# EAGLE design BMM (EAGLE 6.5.0)
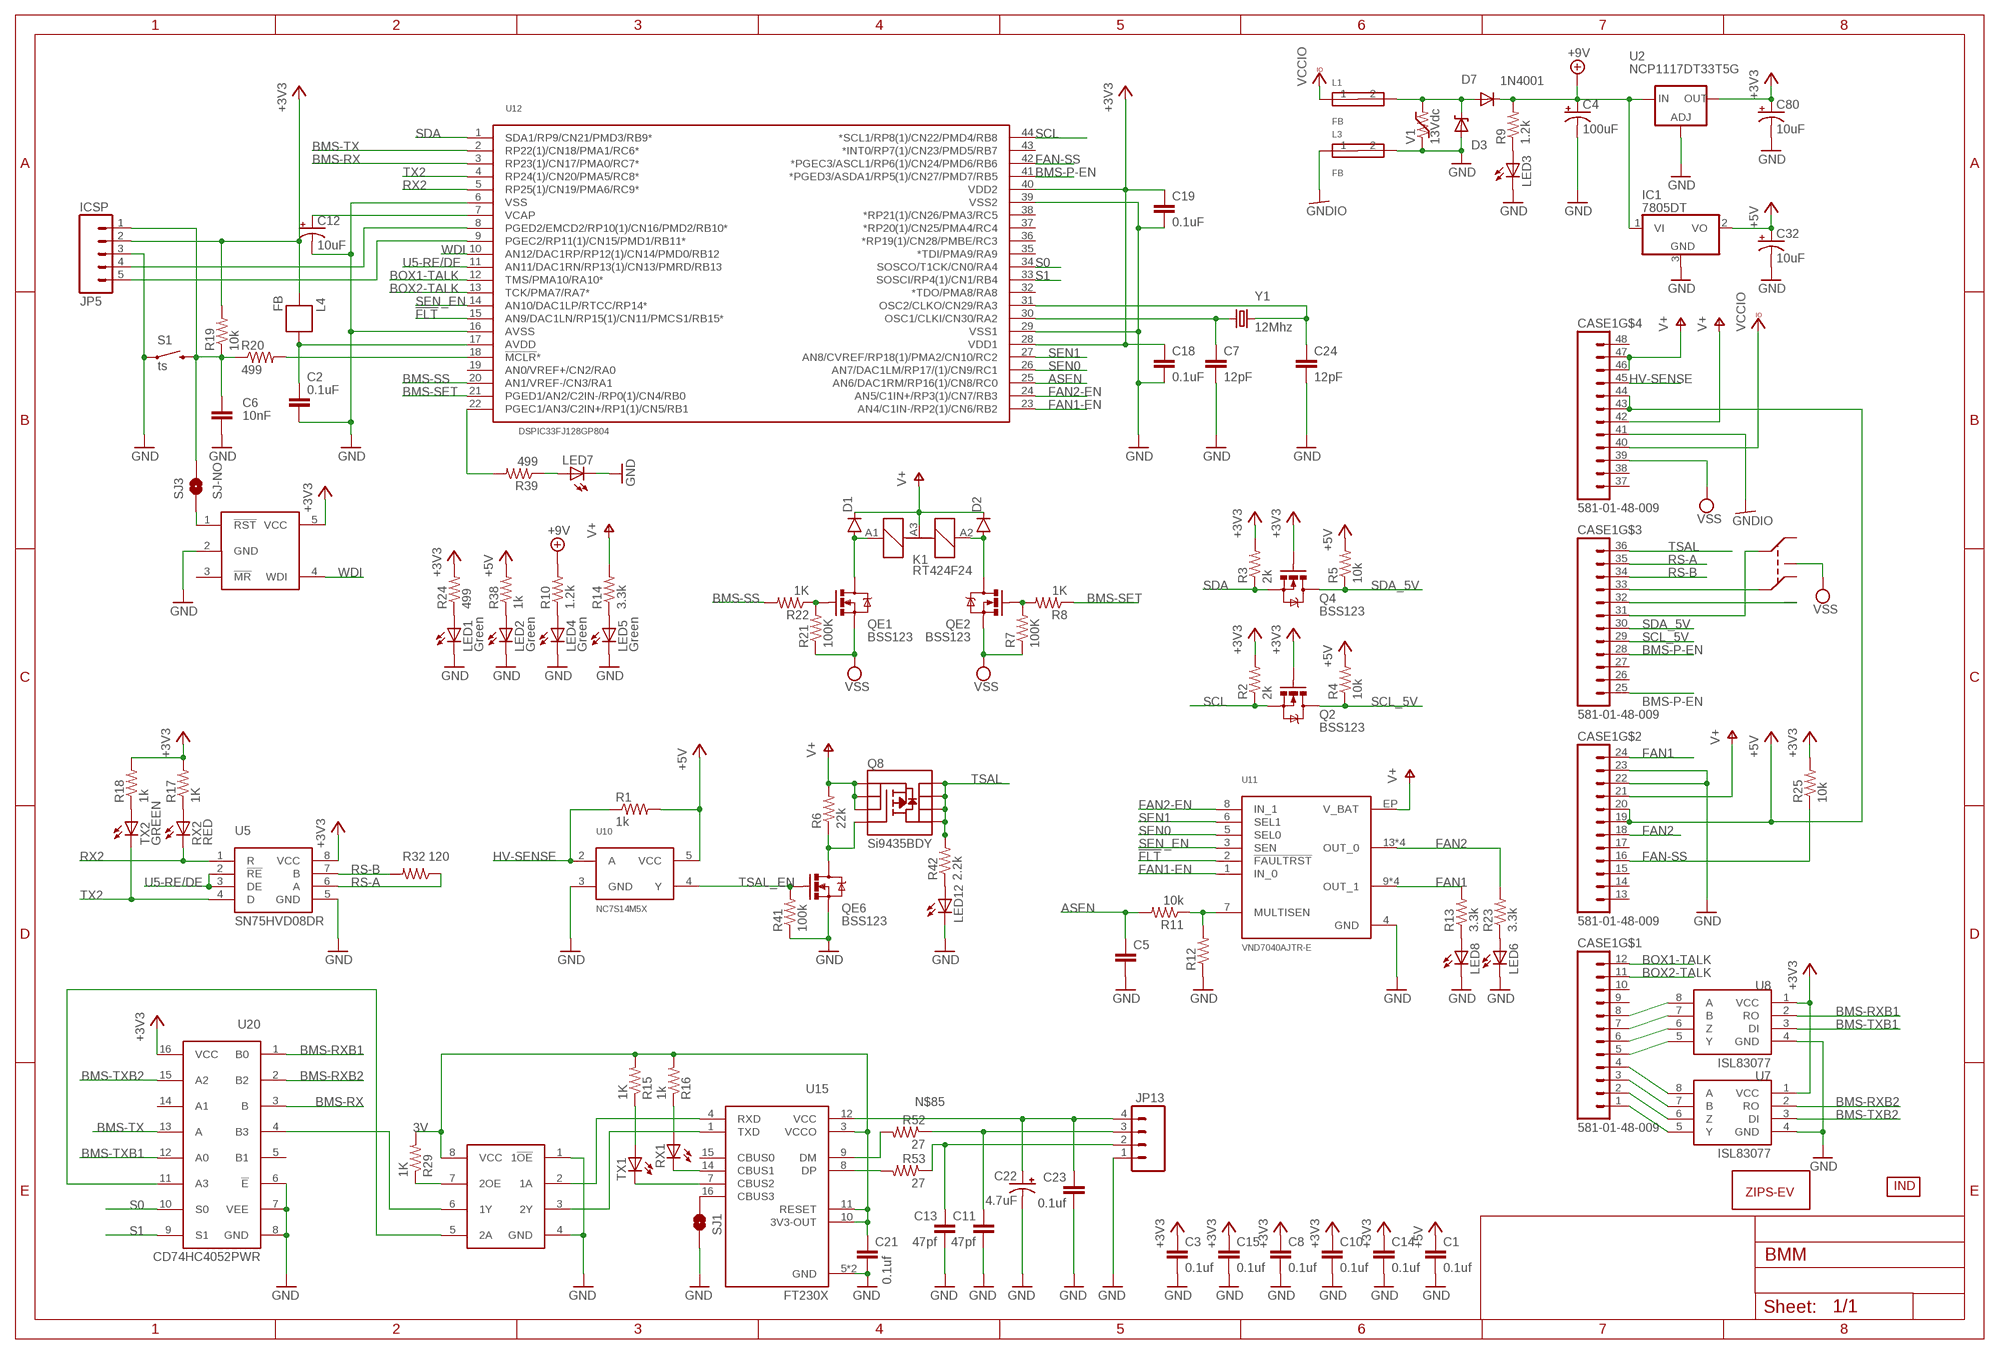
[diagram p0: schematic, sheet 1]

## Parts
C1  0.1uf  CAP0805  [0805]
C2  0.1uF  CAP0805  [0805]
C3  0.1uf  CAP0805  [0805]
C4  100uF  CAP_POL7343  [EIA7343]
C5  CAP0805  [0805]
C6  10nF  CAP0805  [0805]
C7  12pF  CAP0805  [0805]
C8  0.1uf  CAP0805  [0805]
C10  0.1uf  CAP0805  [0805]
C11  47pf  CAP0805  [0805]
C12  10uF  10UF-TANT  [EIA3216]
C13  47pf  CAP0805  [0805]
C14  0.1uf  CAP0805  [0805]
C15  0.1uf  CAP0805  [0805]
C18  0.1uF  CAP0805  [0805]
C19  0.1uF  CAP0805  [0805]
C21  0.1uf  CAP0805  [0805]
C22  4.7uF  CAP_POL1206  [EIA3216]
C23  0.1uf  CAP0805  [0805]
C24  12pF  CAP0805  [0805]
C32  10uF  POLCAP  [POLC1206]
C80  10uF  POLCAP  [POLC1206]
CASE1  581-01-48-009  [581-01-48-009]
D1  DIODESMA  [SMA-DIODE]
D2  DIODESMA  [SMA-DIODE]
D3  MM5Z30  [SOD-523F]
D7  1N4001  DIODE-SOD123  [SOD123]
IC1  7805DT  [TO252]
JP5  ICSP  M05LOCK_LONGPADS  [1X05_LOCK_LONGPADS]
JP13  M04POLAR_LOCK  [MOLEX-1X4_LOCK]
K1  RT424F24  [RT424F24]
L1  FB  FERITEBEAD  [0603]
L3  FB  FERITEBEAD  [0603]
L4  FB  [0603]
LED1  Green  LEDCHIPLED_0805  [CHIPLED_0805]
LED2  Green  LEDCHIPLED_0805  [CHIPLED_0805]
LED3  LEDCHIP-LED0805  [CHIP-LED0805]
LED4  Green  LEDCHIPLED_0805  [CHIPLED_0805]
LED5  Green  LEDCHIPLED_0805  [CHIPLED_0805]
LED6  LEDCHIPLED_0805  [CHIPLED_0805]
LED7  LEDCHIP-LED0805  [CHIP-LED0805]
LED8  LEDCHIPLED_0805  [CHIPLED_0805]
LED12  LEDCHIP-LED0805  [CHIP-LED0805]
Q2  BSS123  MOSFET-NCHANNELBSS123LT1G  [SOT23-3]
Q4  BSS123  MOSFET-NCHANNELBSS123LT1G  [SOT23-3]
Q8  Si9435BDY  MOSFET-PCHANNEL-SOIC8SOIC8  [SO08]
QE1  BSS123  [SOT-23]
QE2  BSS123  [SOT-23]
QE6  BSS123  [SOT-23]
R1  1k  RESISTOR0805-RES  [0805]
R2  2k  RESISTOR0805-RES  [0805]
R3  2k  RESISTOR0805-RES  [0805]
R4  10k  RESISTOR0805-RES  [0805]
R5  10k  RESISTOR0805-RES  [0805]
R6  22k  RESISTOR0805-RES  [0805]
R7  100K  R-US_R0805  [R0805]
R8  1K  R-US_R0805  [R0805]
R9  1.2k  R-US_R0805  [R0805]
R10  1.2k  R-US_R0805  [R0805]
R11  10k  RESISTOR0805-RES  [0805]
R12  RESISTOR0805-RES  [0805]
R13  3.3k  RESISTOR0805-RES  [0805]
R14  3.3k  R-US_R0805  [R0805]
R15  1K  R-US_R0805  [R0805]
R16  1k  R-US_R0805  [R0805]
R17  1K  R-US_R0805  [R0805]
R18  1k  R-US_R0805  [R0805]
R19  10k  RESISTOR0805-RES  [0805]
R20  499  RESISTOR0805-RES  [0805]
R21  100K  R-US_R0805  [R0805]
R22  1K  R-US_R0805  [R0805]
R23  3.3k  RESISTOR0805-RES  [0805]
R24  499  R-US_R0805  [R0805]
R25  10k  RESISTOR0805-RES  [0805]
R29  1K  R-US_R0805  [R0805]
R32  120  R-US_R0805  [R0805]
R38  1k  R-US_R0805  [R0805]
R39  499  RESISTOR0805-RES  [0805]
R41  100k  RESISTOR0805-RES  [0805]
R42  2.2k  RESISTOR0805-RES  [0805]
R52  27  RESISTOR0805-RES  [0805]
R53  27  RESISTOR0805-RES  [0805]
RX1  LEDCHIPLED_0805  [CHIPLED_0805]
RX2  RED  LEDCHIPLED_0805  [CHIPLED_0805]
S1  ts  SWITCH-MOMENTARY-2PTH  [TACTILE-PTH]
SJ1  JUMPER-PAD-2-NOYES_SILK  [PAD-JUMPER-2-NO_YES_SILK]
SJ3  SJ-NO  SOLDERJUMPERNO  [SJ_2S-NO]
TX1  LEDCHIPLED_0805  [CHIPLED_0805]
TX2  GREEN  LEDCHIPLED_0805  [CHIPLED_0805]
U2  NCP1117DT33T5G  V_REG_317DPACK  [V-REG_DPACK]
U4  SN74LVC2G241DCTR  [VFSOP-8]
U5  SN75HVD08DR  [SO-8]
U7  ISL83077  [SO08]
U8  ISL83077  [SO08]
U9  MAX823  [SOT23-5L]
U10  NC7S14M5X  [SOT23-5]
U11  VND7040AJTR-E  [SSO-16-POWER]
U12  DSPIC33FJ128GP804  [TQFP-44]
U15  FT230X  [SSOP-16]
U20  CD74HC4052PWR  [TSSOP-16]
U$1  LOGOM  [L-M]
U$2  INDPK1  [PICKIT-PIN-1]
V1  13Vdc  VAR-RES  [0603]
Y1  12Mhz  CRYSTAL5X3  [CRYSTAL-SMD-5X3]

## Nets
3V: C21.1 R15.2 R16.2 R29.2 U4.8(VCC) U15.3(VCCO) U15.10(3V3-OUT) U15.11(RESET)
!FLT: U11.2(!FAULTRST) U12.15(AN9/DAC1LN/RP15(1)/CN11/PMCS1/RB15*)
+3V3: C3.1 C8.1 C10.1 C14.1 C15.1 C18.1 C19.1 C80.1(+) JP5.2 L4.2 Q2.1(G) Q4.1(G) R2.2 R3.2 R17.2 R18.2 R19.2 R24.2 R25.2 U2.4(OUT) U5.8(VCC) U7.1(VCC) U8.1(VCC) U9.5(VCC) U12.28(VDD1) U12.40(VDD2) U20.16(VCC)
+5V: C1.1 C32.1(+) CASE1.19 CASE1.20 CASE1.43 CASE1.44 IC1.2(VO) R1.2 R4.2 R5.2 R38.2 U10.5(VCC)
+9V: C4.A(+) D7.C IC1.1(VI) R9.2 R10.2 U2.3(IN)
ASEN: C5.1 R11.2 U12.25(AN6/DAC1RM/RP16(1)/CN8/RC0)
BMS-P-EN: CASE1.25 CASE1.28 U12.41(*PGED3/ASDA1/RP5(1)/CN27/PMD7/RB5)
BMS-RX: U12.3(RP23(1)/CN17/PMA0/RC7*) U20.3(B)
BMS-RXB1: U8.2(RO) U20.1(B0)
BMS-RXB2: U7.2(RO) U20.2(B2)
BMS-SET: R8.1 U12.21(PGED1/AN2/C2IN-/RP0(1)/CN4/RB0)
BMS-SS: R22.2 U12.20(AN1/VREF-/CN3/RA1)
BMS-TX: U12.2(RP22(1)/CN18/PMA1/RC6*) U20.13(A)
BMS-TXB1: U8.3(DI) U20.12(A0)
BMS-TXB2: U7.3(DI) U20.15(A2)
BOX1-TALK: CASE1.12 U12.12(TMS/PMA10/RA10*)
BOX2-TALK: CASE1.11 U12.13(TCK/PMA7/RA7*)
C_N: C7.1 U12.30(OSC1/CLKI/CN30/RA2) Y1.1
C_P: C24.1 U12.31(OSC2/CLKO/CN29/RA3) Y1.3
FAN1: CASE1.24 R13.2 U11.9(OUT_1) U11.10(OUT_1) U11.11(OUT_1) U11.12(OUT_1)
FAN1-EN: U11.1(IN_0) U12.23(AN4/C1IN-/RP2(1)/CN6/RB2)
FAN2: CASE1.18 R23.2 U11.13(OUT_0) U11.14(OUT_0) U11.15(OUT_0) U11.16(OUT_0)
FAN2-EN: U11.8(IN_1) U12.24(AN5/C1IN+/RP3(1)/CN7/RB3)
FAN-SS: CASE1.16 R25.1 U12.42(*PGEC3/ASCL1/RP6(1)/CN24/PMD6/RB6)
GND: C1.2 C2.2 C3.2 C4.C(-) C5.2 C6.2 C7.2 C8.2 C10.2 C11.2 C12.C(-) C13.2 C14.2 C15.2 C18.2 C19.2 C21.2 C22.C(-) C23.2 C24.2 C32.2(-) C80.2(-) CASE1.22 CASE1.23 D3.A IC1.3(GND) JP5.3 JP13.1 L3.2 LED1.C LED2.C LED3.C LED4.C LED5.C LED6.C LED7.C LED8.C LED12.C QE6.2(S) R12.1 R41.1 S1.1 SJ1.1 U2.1(ADJ) U4.1(1!OE) U4.4(GND) U5.5(GND) U7.4(GND) U8.4(GND) U9.2(GND) U10.3(GND) U11.4(GND) U12.6(VSS) U12.16(AVSS) U12.29(VSS1) U12.39(VSS2) U15.5(GND) U15.13(GND) U20.6(!E) U20.7(VEE) U20.8(GND) V1.1
GNDIO: CASE1.41 L3.1
HV-SENSE: CASE1.45 R1.1 U10.2(A)
N$1: LED8.A R13.1
N$3: D1.A K1.A1(+1) QE1.3(D)
N$4: LED1.A R24.1
N$5: D2.A K1.A2(+2) QE2.3(D)
N$6: LED6.A R23.1
N$7: QE2.1(G) R7.2 R8.2
N$8: LED3.A R9.1
N$10: R11.1 R12.2 U11.7(MULTISEN)
N$11: LED4.A R10.1
N$12: LED5.A R14.1
N$13: CASE1.33 K1.21(C2)
N$14: R52.2 U15.9(DM)
N$15: R15.1 TX1.A
N$16: R16.1 RX1.A
N$17: TX1.C U15.7(CBUS2)
N$18: RX1.C U15.14(CBUS1)
N$19: R18.1 TX2.A
N$20: U4.2(1A) U15.4(RXD)
N$21: U4.3(2Y) U15.1(TXD)
N$22: LED2.A R38.1
N$23: LED7.A R39.1
N$25: CASE1.1 U7.5(Y)
N$27: SJ3.1 U9.1(!RST)
N$28: C2.1 L4.1 U12.17(AVDD)
N$29: C12.A(+) U12.7(VCAP)
N$30: QE1.1(G) R21.2 R22.1
N$31: CASE1.2 U7.6(Z)
N$33: CASE1.3 U7.7(B)
N$34: CASE1.4 U7.8(A)
N$35: CASE1.5 U8.5(Y)
N$36: CASE1.32 K1.24(NO2)
N$37: CASE1.6 U8.6(Z)
N$38: CASE1.7 U8.7(B)
N$39: CASE1.8 U8.8(A)
N$40: R17.1 RX2.A
N$42: CASE1.31 K1.11(C1)
N$43: Q8.4(G) QE6.3(D) R6.1
N$44: R39.2 U12.22(PGEC1/AN3/C2IN+/RP1(1)/CN5/RB1)
N$45: C6.1 JP5.1 R19.1 R20.1 S1.3 SJ3.2
N$46: R20.2 U12.18(!MCLR!*)
N$47: JP5.4 U12.8(PGED2/EMCD2/RP10(1)/CN16/PMD2/RB10*)
N$48: JP5.5 U12.9(PGEC2/RP11(1)/CN15/PMD1/RB11*)
N$50: LED12.A R42.1
N$54: R53.2 U15.8(DP)
N$55: C11.1 JP13.3 R52.1
N$61: C13.1 JP13.2 R53.1
N$62: SJ1.2 U15.16(CBUS3)
N$63: D3.C D7.A L1.2 V1.2
N$69: R29.1 U4.7(2OE)
N$72: U4.6(1Y) U20.4(B3)
N$78: U4.5(2A) U20.11(A3)
N$85: C22.A(+) C23.1 JP13.4 U15.12(VCC)
RS-A: CASE1.35 R32.1 U5.6(A)
RS-B: CASE1.34 R32.2 U5.7(B)
RX2: RX2.C U5.1(R) U12.5(RP25(1)/CN19/PMA6/RC9*)
S0: U12.34(SOSCO/T1CK/CN0/RA4) U20.10(S0)
S1: U12.33(SOSCI/RP4(1)/CN1/RB4) U20.9(S1)
SCL: Q2.2(S) R2.1 U12.44(*SCL1/RP8(1)/CN22/PMD4/RB8)
SCL_5V: CASE1.29 Q2.3(D) R4.1
SDA: Q4.2(S) R3.1 U12.1(SDA1/RP9/CN21/PMD3/RB9*)
SDA_5V: CASE1.30 Q4.3(D) R5.1
SEN0: U11.5(SEL0) U12.26(AN7/DAC1LM/RP17/(1)/CN9/RC1)
SEN1: U11.6(SEL1) U12.27(AN8/CVREF/RP18(1)/PMA2/CN10/RC2)
SEN_EN: U11.3(SEN) U12.14(AN10/DAC1LP/RTCC/RP14*)
TSAL: CASE1.36 Q8.5(D) Q8.6(D) Q8.7(D) Q8.8(D) R42.2
TSAL_EN: QE6.1(G) R41.2 U10.4(Y)
TX2: TX2.C U5.4(D) U12.4(RP24(1)/CN20/PMA5/RC8*)
U5-RE/DE: U5.2(!RE) U5.3(DE) U12.11(AN11/DAC1RN/RP13(1)/CN13/PMRD/RB13)
V+: CASE1.21 CASE1.42 CASE1.46 CASE1.47 D1.C D2.C K1.A3(-) Q8.1(S) Q8.2(S) Q8.3(S) R6.2 R14.2 U11.EP(V_BAT)
VCCIO: CASE1.40 L1.1
VSS: CASE1.39 K1.14(NO1) QE1.2(S) QE2.2(S) R7.1 R21.1
WDI: U9.4(WDI) U12.10(AN12/DAC1RP/RP12(1)/CN14/PMD0/RB12)
Unconnected: CASE1.9 CASE1.10 CASE1.13 CASE1.14 CASE1.15 CASE1.17 CASE1.26 CASE1.27 CASE1.37 CASE1.38 CASE1.48 K1.12(NC1) K1.22(NC2) U9.3(!MR) U12.19(AN0/VREF+/CN2/RA0) U12.32(*TDO/PMA8/RA8) U12.35(*TDI/PMA9/RA9) U12.36(*RP19(1)/CN28/PMBE/RC3) U12.37(*RP20(1)/CN25/PMA4/RC4) U12.38(*RP21(1)/CN26/PMA3/RC5) U12.43(*INT0/RP7(1)/CN23/PMD5/RB7) U15.15(CBUS0) U20.5(B1) U20.14(A1)

## Library data of the parts
C1 C3 C8 C10 C11 C13-C15 C21 C23 = SparkFun:CAP: Capacitor Standard 0603 ceramic capacitor, and 0.1" leaded capacitor.
C2 C6 C7 C18 C19 C24 = SparkFun-Capacitors:CAP: Capacitor Standard 0603 ceramic capacitor, and 0.1" leaded capacitor.
C4 = SparkFun-Capacitors:CAP_POL: Capacitor Polarized These are standard SMD and PTH capacitors. Normally 10uF, 47uF, and 100uF in electrolytic and tantalum varieties. Always verify the external diameter of the through hole cap, it varies with capacity, voltage, and manufacturer. The EIA devices should be standard.
C5 = SparkFun-Passives:CAP: Capacitor Standard 0603 ceramic capacitor, and 0.1" leaded capacitor.
C12 = SparkFun-Capacitors:10UF-TANT: 10uF Tantalum SMT CAP-00811- 16V 10% (EIA-3216); PROD_ID: CAP-00811
C22 = SparkFun:CAP_POL: Capacitor Polarized These are standard SMD and PTH capacitors. Normally 10uF, 47uF, and 100uF in electrolytic and tantalum varieties. Always verify the external diameter of the through hole cap, it varies with capacity, voltage, and manufacturer. The EIA devices should be standard.
C32 C80 = RJ's_parts:POLCAP
CASE1 = FSAE Eletric:581-01-48-009
D1 D2 = SparkFun-DiscreteSemi:DIODE: Diode These are standard reverse protection diodes and small signal diodes. SMA package can handle up to about 1A. SOD-323 can handle about 200mA. What the SOD-323 package when ordering, there are some mfgs out there that are 5-pin packages.
D3 = EmEndev:MM5Z30
D7 = diode:DIODE-: DIODE
IC1 = adafruit:78*: Positive VOLTAGE REGULATOR Added bigger pads to the TO-92 package
JP5 = SparkFun-Connectors:M05: Header 5 Standard 5-pin 0.1" header. Use with straight break away headers (SKU : PRT-00116), right angle break away headers (PRT-00553), swiss pins (PRT-00743), machine pins (PRT-00117), and female headers (PRT-00115). Molex polarized connector foot print use with SKU : PRT-08230 with associated crimp pins and housings.
JP13 = SparkFun-Connectors:M04: Header 4 Standard 4-pin 0.1" header. Use with straight break away headers (SKU : PRT-00116), right angle break away headers (PRT-00553), swiss pins (PRT-00743), machine pins (PRT-00117), and female headers (PRT-00115). Molex polarized connector foot print use with SKU : PRT-08231 with associated crimp pins and housings. 1MM SMD Version SKU: PRT-10208
K1 = FSAE Eletric:RT424F24
L1 L3 = EmEndev:FERITEBEAD
L4 = SparkFun-Passives:FB
LED1-LED8 LED12 RX1 RX2 TX1 TX2 = adafruit:LED: LED OSRAM: - CHIPLED LG R971, LG N971, LY N971, LG Q971, LY Q971, LO R971, LY R971 LH N974, LH R974 LS Q976, LO Q976, LY Q976 LO Q996 - Hyper CHIPLED LW Q18S LB Q993, LB Q99A, LB R99A - SideLED LS A670, LO A670, LY A670, LG A670, LP A670 LB A673, LV A673, LT A673, LW A673 LH A674 LY A675 LS A676, LA A676, LO A676, LY A676, LW A676 LS A679, LY A679, LG A679 - Hyper Micro SIDELED® LS Y876, LA Y876, LO Y876, LY Y876 LT Y87S - SmartLED LW L88C, LW L88S LB L89C, LB L89S, LG L890 LS L89K, LO L89K, LY L89K LS L896, LA L896, LO L896, LY L896 - TOPLED LS T670, LO T670, LY T670, LG T670, LP T670 LSG T670, LSP T670, LSY T670, LOP T670, LYG T670 LG T671, LOG T671, LSG T671 LB T673, LV T673, LT T673, LW T673 LH T674 LS T676, LA T676, LO T676, LY T676, LB T676, LH T676, LSB T676, LW T676 LB T67C, LV T67C, LT T67C, LS T67K, LO T67K, LY T67K, LW E67C LS E67B, LA E67B, LO E67B, LY E67B, LB E67C, LV E67C, LT E67C LW T67C LS T679, LY T679, LG T679 LS T770, LO T770, LY T770, LG T770, LP T770 LB T773, LV T773, LT T773, LW T773 LH T774 LS E675, LA E675, LY E675, LS T675 LS T776, LA T776, LO T776, LY T776, LB T776 LHGB T686 LT T68C, LB T68C - Hyper Mini TOPLED® LB M676 - Mini TOPLED Santana® LG M470 LS M47K, LO M47K, LY M47K Source: http://www.osram.convergy.de/
Q2 Q4 = SparkFun-DiscreteSemi:MOSFET-NCHANNEL: Common NMOSFET Parts MFG P/NStore IDProd ID FDD8780TRANS-09984 SI7820DNTRANS-11055 FDS6630AIC-08089 2N7002PWTRANS-11151 FQP30N06L COM-10213TRANS-10060 BSS123LT1GTRANS-08345 BSS138TRANS-00830 BS170 2N7000; PROD_ID: TRANS-08345
Q8 = SparkFun-DiscreteSemi:MOSFET-PCHANNEL-SOIC8: Generic 8-pin PMOSFET
QE1 QE2 QE6 = DFT:BSS123
R1 R20 = SparkFun-Resistors:RESISTOR: Resistor Basic schematic elements and footprints for 0603, 1206, and PTH resistors.
R2-R5 R11-R13 R19 R23 R25 R39 R52 R53 = SparkFun-Passives:RESISTOR: Resistor Basic schematic elements and footprints for 0603, 1206, and PTH resistors.
R6 R41 R42 = SparkFun:RESISTOR: Resistor Basic schematic elements and footprints for 0603, 1206, and PTH resistors.
R7-R10 R14-R18 R21 R22 R24 R29 R32 R38 = adafruit:R-US_: RESISTOR, American symbol
S1 = SparkFun-Electromechanical:SWITCH-MOMENTARY-2: Various NO switches- pushbuttons, reed, etc
SJ1 = SparkFun-Passives:JUMPER-PAD-2-NO
SJ3 = SparkFun-Passives:SOLDERJUMPER: Solder Jumper Standard SMD solder jumper. Used to automate production. Two varients : Normally Open and Normally Closed are the same, but have different paste layers. NC will have a large amount of paste and should jumper during reflow.
U2 = SparkFun-PowerIC:V_REG_317: Voltage Regulator Standard LM317 adjustable voltage regulator. AOI (Adjust Output Input). Google 'LM317 Calculator' for easy to use app to get the two resistor values needed. 240/720 for 5V output. 240/390 for 3.3V output. Spark Fun Electronics SKU : COM-00527
U4 = Cleaverbrooks:SN74LVC2G241DCTR
U5 = FSAE Eletric:SN75HVD08DR
U7 U8 = NASA_LIB:ISL83077
U9 = NASA_LIB:MAX823
U10 = FSAE Eletric:NC7S14M5X
U11 = FSAE Eletric:VND7040AJTR-E
U12 = FSAE Eletric:DSPIC33FJ128GP804
U15 = FSAE Eletric:FT230X
U20 = NASA_LIB:CD74HC4052PWR
U$1 = Pic:LOGO
U$2 = FSAE Eletric (2):IND
V1 = EmEndev:VAR-RES
Y1 = SparkFun-FreqCtrl:CRYSTAL: Various standard crystals. Proven footprints. Spark Fun Electronics SKU : COM-00534

## Board
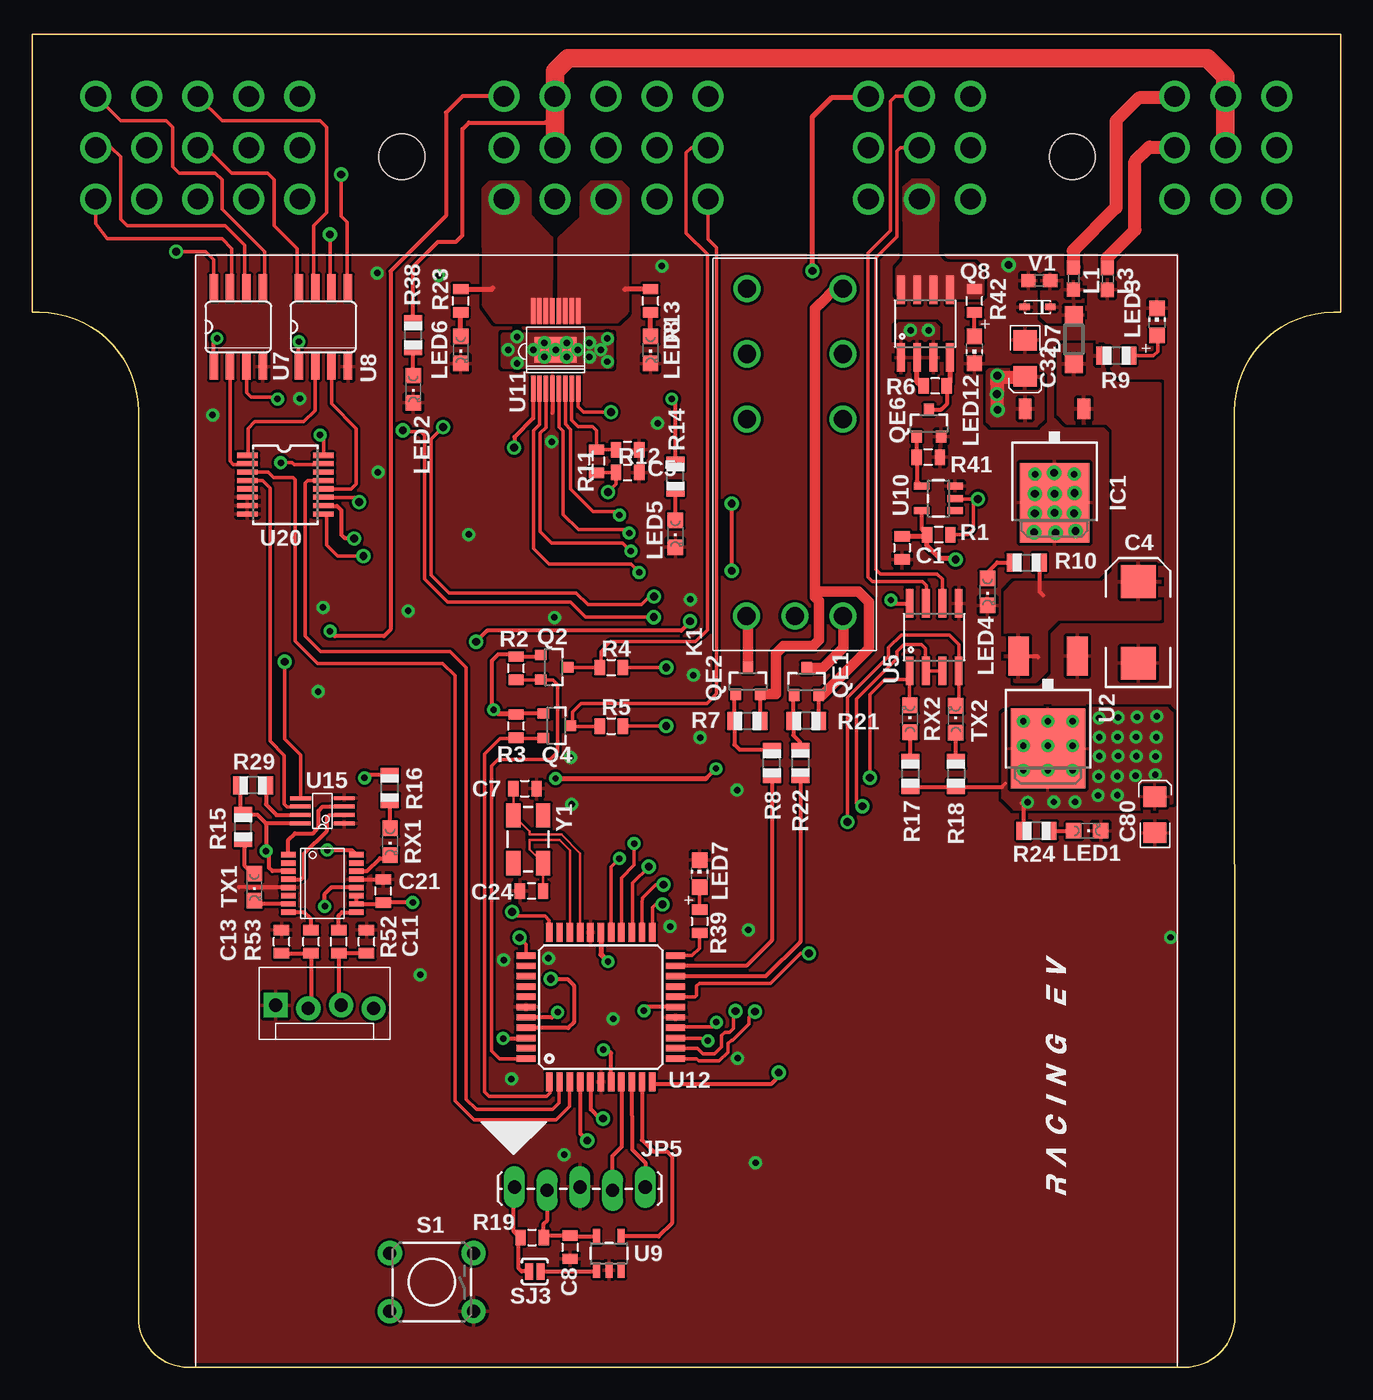
[diagram p1: board, top side]
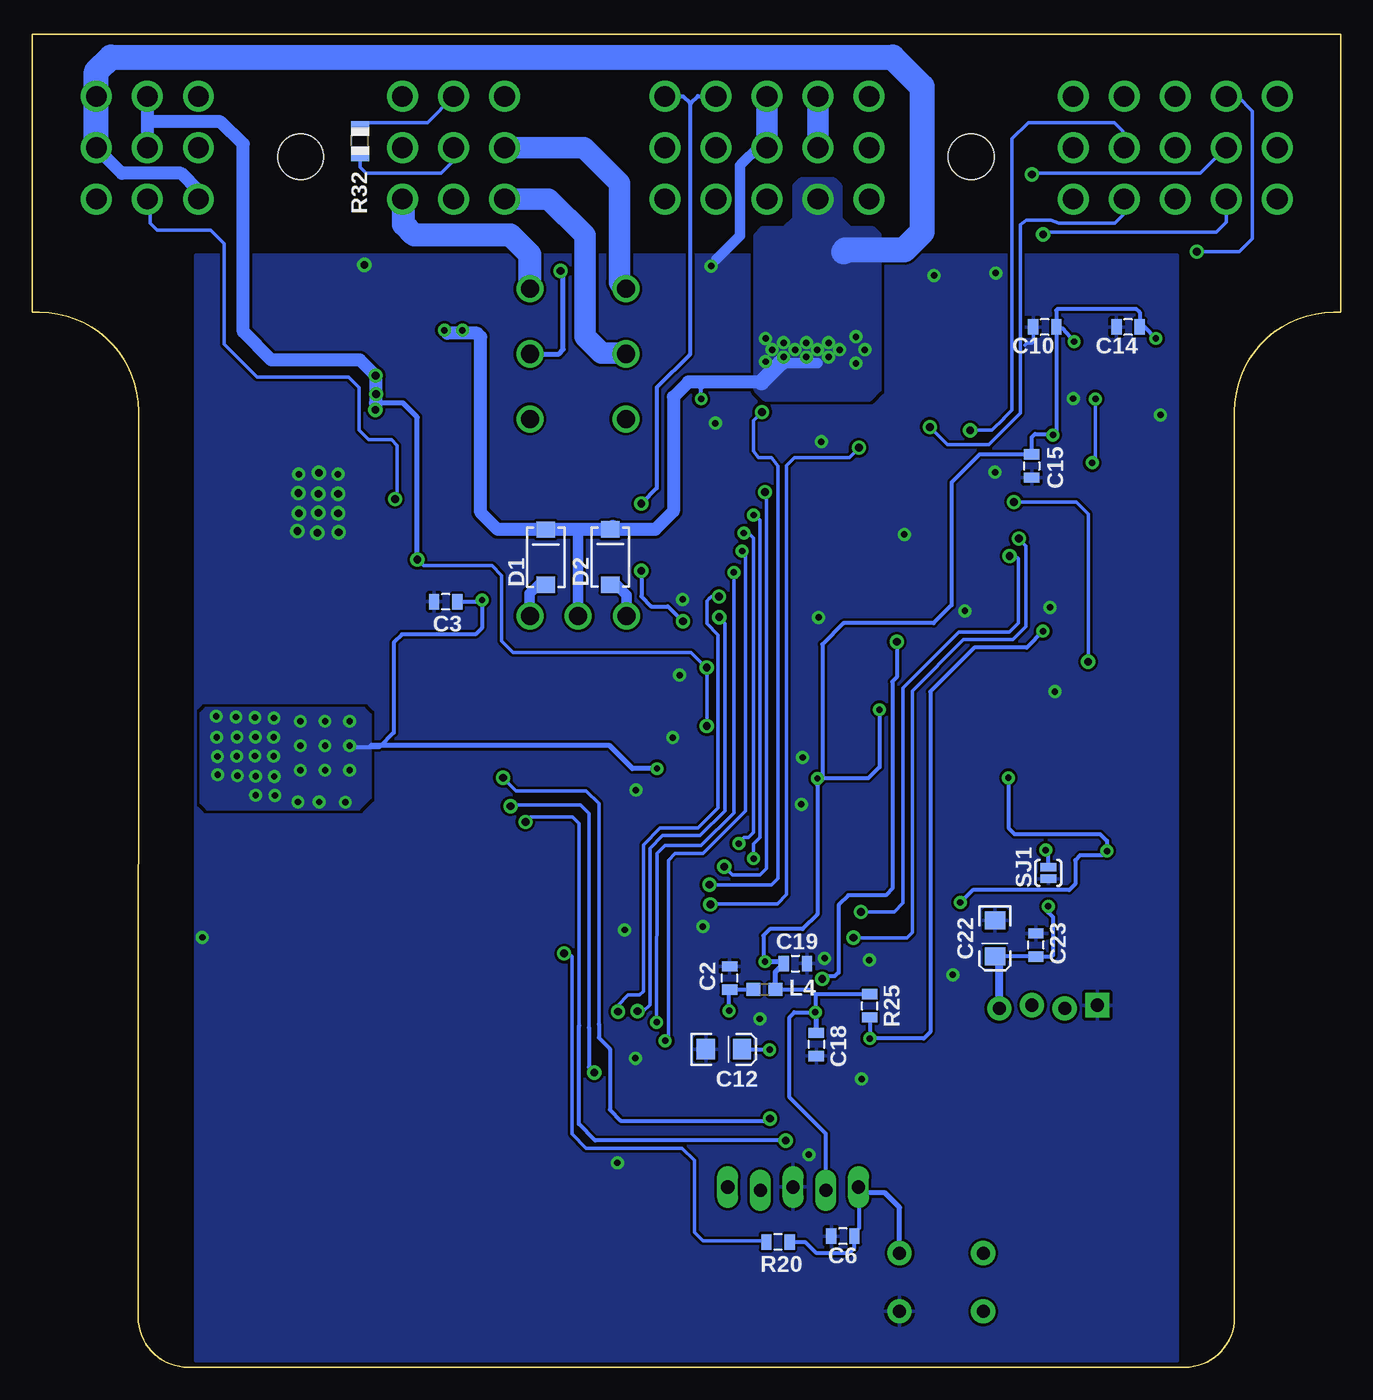
[diagram p2: board, bottom side, seen from below]

Size 101.6 x 103.51 mm. Coordinates in mm from the lower left corner, seen from the top.
Copper layers (1*16): Top 0.035mm / dielectric 1.5mm / Bottom 0.035mm
Design rules "SparkFun": minimum track width 8mil, minimum drill 20mil, track to track 8mil, track to pad 8mil, pad to pad 8mil, via to via 8mil, smd to smd 8mil, copper to edge 10mil, drill to drill 8mil, minimum pad ring 12mil, minimum via ring 10mil, stop-mask expansion 4mil, vias tented up to drill 25mil, thermal gap 10mil
